# EasyEDA Pro project BlueberryPi.eprj, board PCB1 (continued)
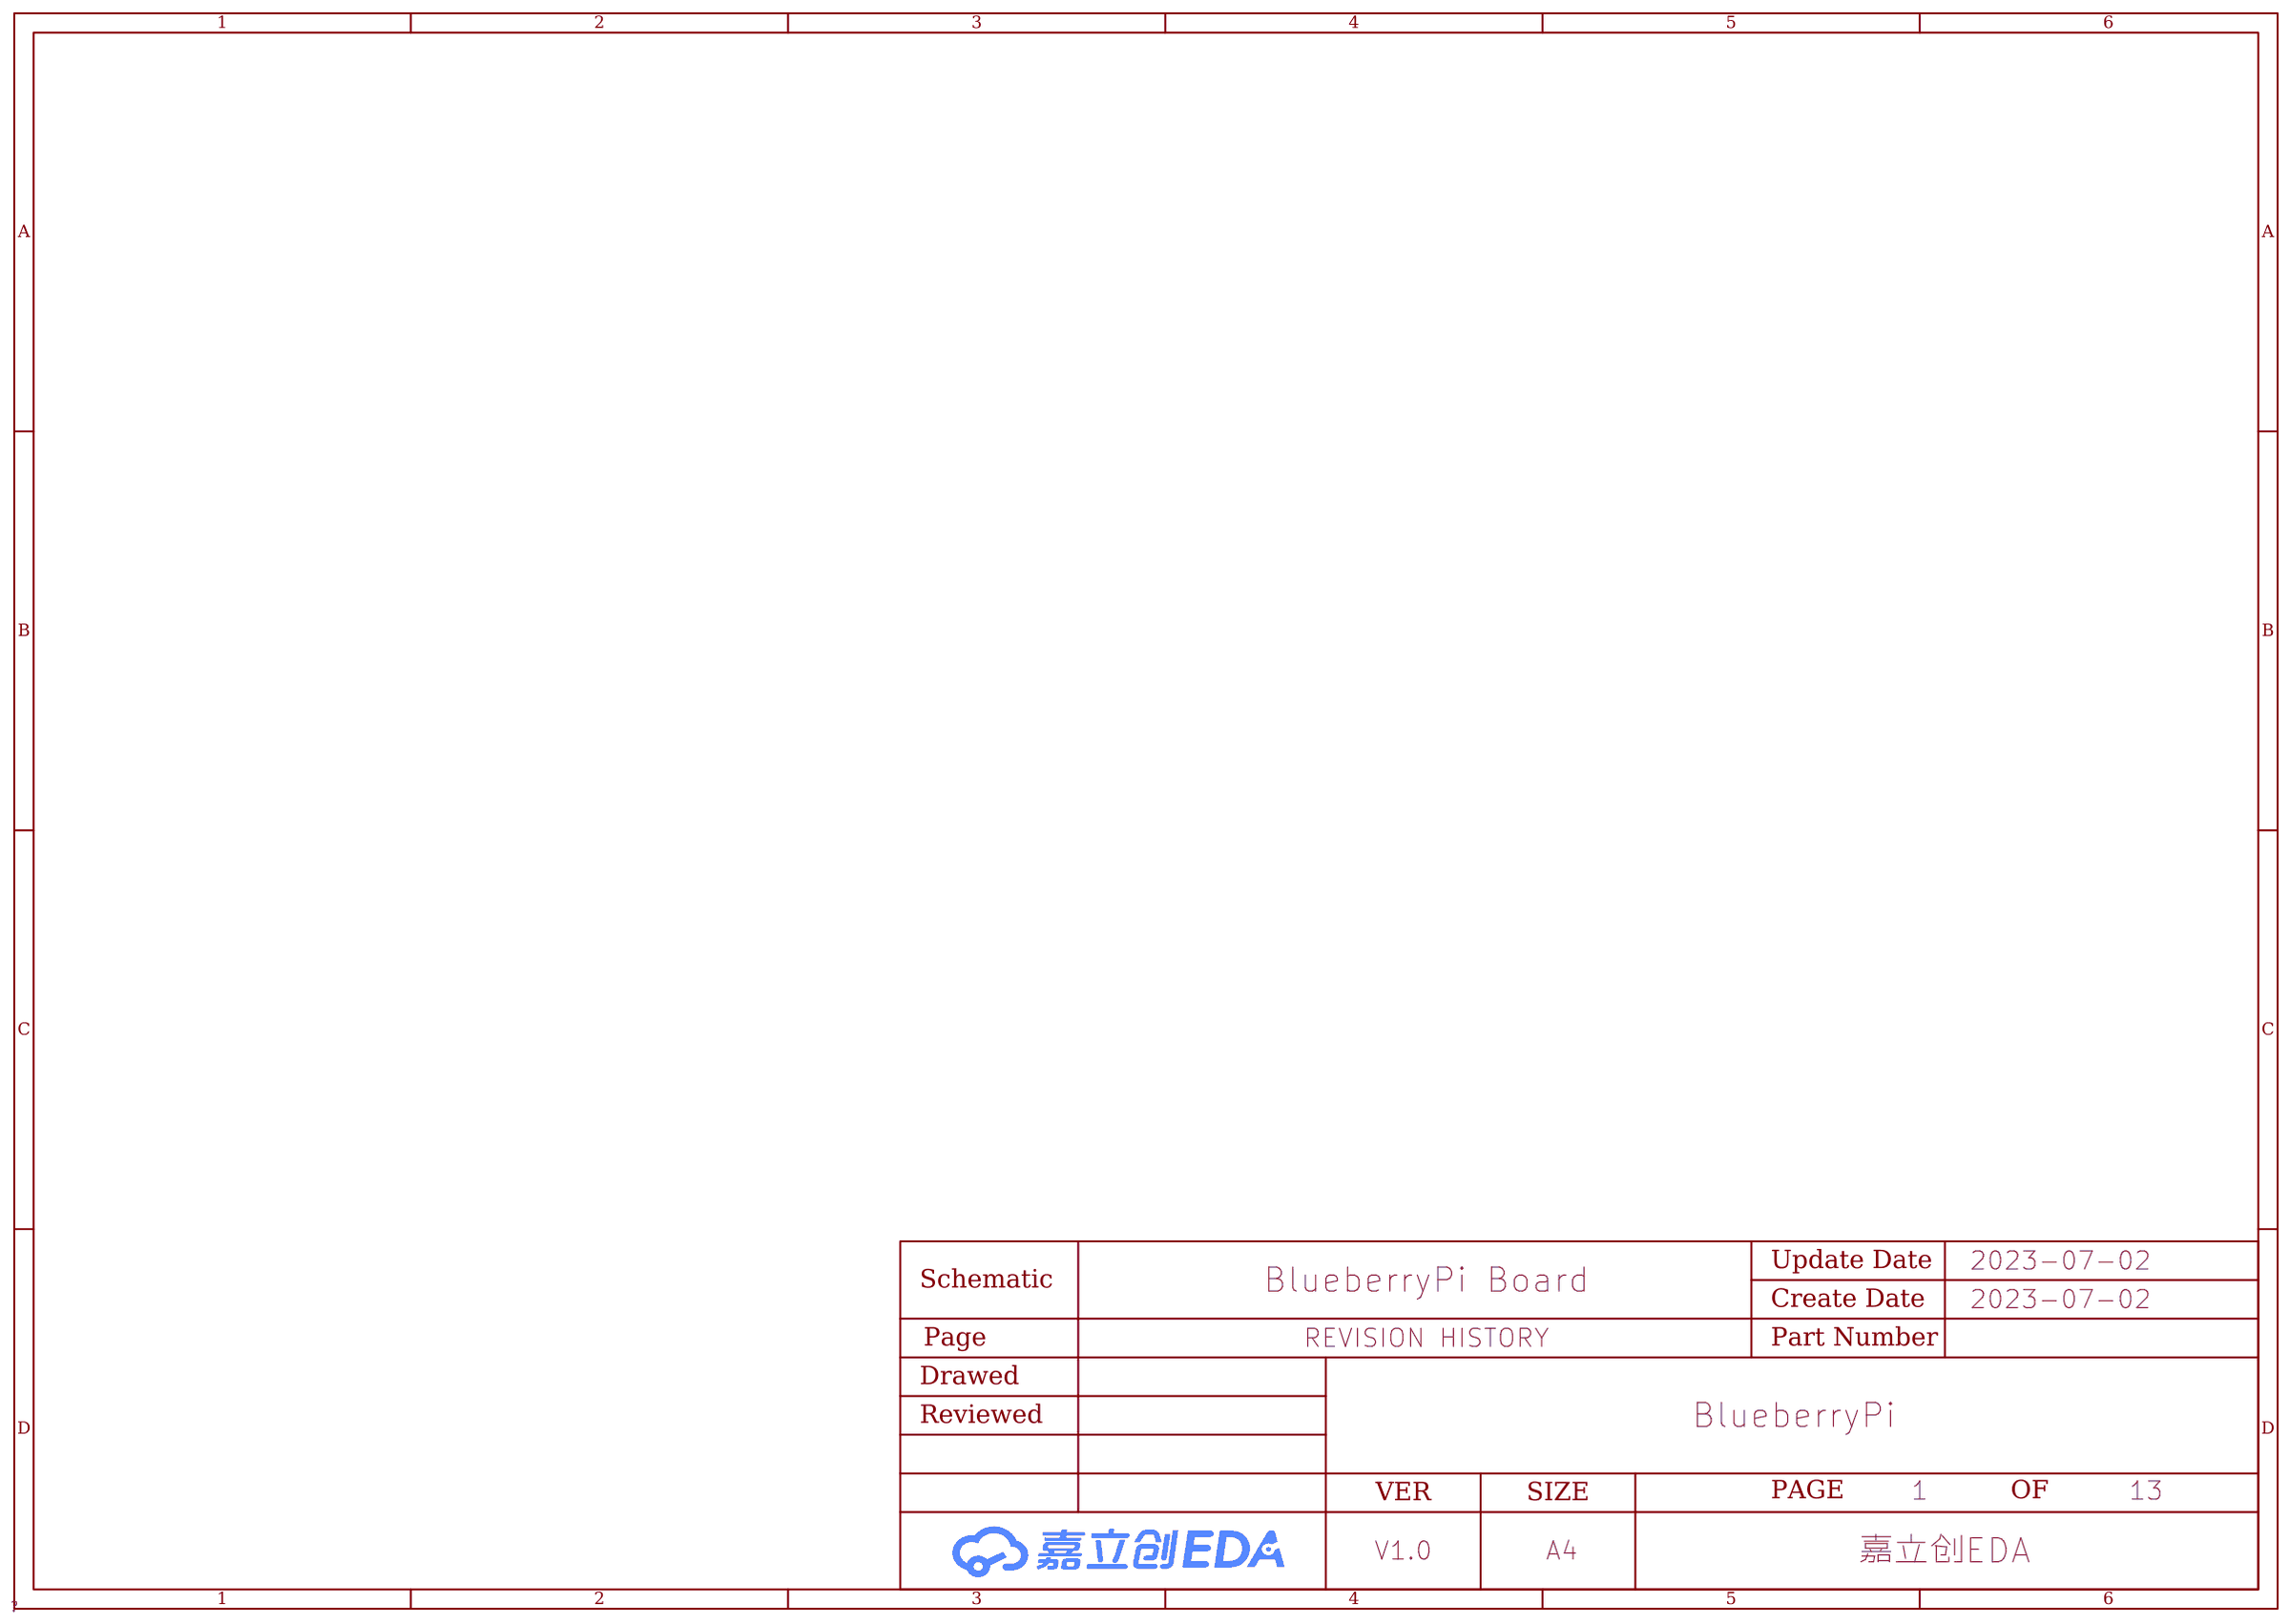
[diagram p0: REVISION HISTORY]
## Routing (per net, layer and track width the routed paths; a pad name or vN(x,y) marks a point on that pad's centre or on a via; arc(x,y) is an arc through that point) (continued)
SODT0: length 36.7
  Top Layer w0.127: U35.J8 48.37,27.58 45.45,27.58 v2(45.29,27.75)
  Bottom Layer w0.127: v2(45.29,27.75) 44.65,28.38 44.65,31.01 44.16,31.51 44.16,33.6 arc(44.2,33.68) 44.28,33.72 arc(44.37,33.75) 44.4,33.84 44.4,33.85 arc(44.37,33.94) 44.28,33.97 arc(44.2,34.01) 44.16,34.09 44.16,34.1 arc(44.2,34.19) 44.28,34.23 arc(44.37,34.26) 44.4,34.35 44.4,34.36 arc(44.37,34.44) 44.28,34.48 arc(44.2,34.52) 44.16,34.6 44.16,34.61 arc(44.2,34.7) 44.28,34.73 arc(44.37,34.77) 44.4,34.86 44.4,34.87 arc(44.37,34.95) 44.28,34.99 arc(44.2,35.02) 44.16,35.11 44.16,35.12 arc(44.2,35.21) 44.28,35.24 arc(44.37,35.28) 44.4,35.36 44.4,35.37 arc(44.37,35.46) 44.28,35.5 arc(44.2,35.53) 44.16,35.62 44.16,35.63 arc(44.2,35.71) 44.28,35.75 arc(44.37,35.79) 44.4,35.87 44.4,35.88 arc(44.37,35.97) 44.28,36 arc(44.2,36.04) 44.16,36.13 44.16,36.14 arc(44.2,36.22) 44.28,36.26 arc(44.37,36.29) 44.4,36.38 44.4,36.39 arc(44.37,36.48) 44.28,36.51 arc(44.2,36.55) 44.16,36.63 44.16,36.64 arc(44.2,36.73) 44.28,36.77 arc(44.37,36.8) 44.4,36.89 44.4,36.9 arc(44.37,36.98) 44.28,37.02 arc(44.2,37.06) 44.16,37.14 44.16,37.15 arc(44.2,37.24) 44.28,37.27 arc(44.37,37.31) 44.4,37.4 44.4,37.41 arc(44.37,37.49) 44.28,37.53 arc(44.2,37.56) 44.16,37.65 44.16,37.66 arc(44.2,37.75) 44.28,37.78 arc(44.37,37.82) 44.4,37.9 44.4,37.91 arc(44.37,38) 44.28,38.04 arc(44.2,38.07) 44.16,38.16 44.16,38.17 arc(44.2,38.25) 44.28,38.29 arc(44.37,38.33) 44.4,38.41 44.4,38.42 arc(44.37,38.51) 44.28,38.54 arc(44.2,38.58) 44.16,38.67 44.16,38.95 47.19,41.98 arc(47.28,42.02) 47.37,41.98 48.1,41.25 arc(48.28,41.25) 48.28,41.43 47.55,42.16 arc(47.55,42.34) 47.73,42.34 48.46,41.61 arc(48.64,41.61) 48.64,41.79 47.91,42.52 arc(47.91,42.7) 48.09,42.7 48.82,41.97 arc(49,41.97) 49,42.15 48.27,42.88 arc(48.27,43.06) 48.45,43.06 49.18,42.33 arc(49.36,42.33) 49.36,42.51 48.63,43.24 arc(48.59,43.33) 48.63,43.42 48.89,43.68 v2(50.18,43.68)
SPI1-CLK: length 153.1
  Top Layer w0.127: U1.E12 49.87,54.42 49.87,54.9 49.73,55.04 49.38,55.04 48.87,55.55 48.87,56.81 48.45,57.23 48.2,57.23 47.35,58.08 46.99,58.08 46.52,58.55 v2(46.52,64.12)
  03SIG w0.127: v2(46.52,64.12) 46.52,65.44 50.99,69.91 84.49,69.91 91.08,63.32 91.08,9.49 87.6,6.01 67.54,6.01 65.53,8.01 62.05,8.01 60.96,6.92 60.96,4.76 61.91,3.81 U7.23
SPI1-CS: length 150.2
  Top Layer w0.127: v2(45.72,63.16) 45.72,58.6 46.75,57.57 47.1,57.57 47.9,56.77 47.9,55.85 48.88,54.88 U1.D11
  03SIG w0.127: v2(45.72,63.16) 45.72,65.79 50.43,70.5 84.85,70.5 92.48,62.87 92.48,9.87 87.74,5.13 63.45,5.13 U7.24
SPI1-MISO: length 156.5
  Top Layer w0.127: v2(45.33,63.7) 45.33,58.52 46.57,57.28 46.75,57.28 47.26,56.77 47.26,55.85 47.41,55.7 47.7,55.7 47.88,55.52 47.88,55.03 U1.D9
  03SIG w0.127: v2(45.33,63.7) 45.33,65.98 50.13,70.78 85,70.78 93.34,62.44 93.34,9.71 85.64,2.01 61.49,2.01 U7.21
SPI1-MOSI: length 168.7
  Bottom Layer w0.127: v2(47.58,53.47) 47.89,53.78 47.89,54.66 47.54,55.01 47.54,66.8 58.57,77.83 70.7,77.83 72.15,76.38 72.15,75.63 73.86,73.91 80.3,73.91 81.09,74.7 81.09,75.6 81.48,76 89.26,76 92.32,72.93 92.32,11.14 83.72,2.54 58.42,2.54 U7.19
STATUS-LED: length 24.8
  Top Layer w0.127: U1.J21 55.7,51.16 56.27,51.16 56.59,51.47 57.85,51.47 58.9,50.42 63.76,50.42 68.06,54.71 68.06,58.41 70.61,60.96 v2(72.91,60.96)
SVREF: length 46.3
  Top Layer w0.127: R20.1 47.16,20.03 47.16,19.66 R21.2 ; U35.H4 49.26,25.92 50.33,25.92 50.5,25.76 50.5,25.43 50.75,25.18 51.04,25.18 51.18,25.03 51.18,24.42 51.31,24.3 51.56,24.3 51.79,24.07 v2(51.79,21.69)
  Top Layer w0.254: R20.1 45.53,20.47 v2(45.47,20.41)
  Bottom Layer w0.127: v2(51.79,21.69) 50.51,20.41 v2(45.47,20.41) 45.47,20.98 41.26,25.18 41.26,42.98 43.29,45.01 45.01,45.01 v2(45.63,45.63)
SVREF_DQ: length 6.4
  Top Layer w0.127: 49.86,32.61 49.86,31.47 U35.J11
  Top Layer w0.254: 49.06,35.5 R23.2 ; 49.06,35.5 C72.2 49.06,33.41 49.86,32.61 ; 49.06,35.5 49.15,35.41 R22.1
TWI0-SCK: length 60.5
  Top Layer w0.127: U7.5 40.65,5.09 40.65,8.12 v2(39.37,9.41) ; v2(42.75,9.41) 42.75,10.87 40.11,13.51 36.31,13.51 34.98,14.84 34.98,44.91 36.66,46.6 43.36,46.6 U1.U3
  Bottom Layer w0.127: v2(39.37,9.41) 42.74,9.41 v2(42.75,9.41)
TWI0-SDA: length 64.8
  Top Layer w0.127: U1.R5 44.01,46.61 44.01,46.19 43.78,45.96 36.88,45.96 35.45,44.53 35.45,15.2 36.66,13.98 40.35,13.98 43.6,10.73 v2(43.6,10) ; U7.3 38.11,5.09 38.11,8.12 v2(36.83,9.41)
  Bottom Layer w0.127: v2(43.6,10) 37.42,10 v2(36.83,9.41)
UART3-RX: length 58.9
  Top Layer w0.127: U1.V1 41.73,45.63 41.66,45.55 41.42,45.55 41.24,45.73 40.96,45.73 40.79,45.55 40.51,45.55 40.33,45.73 40.05,45.73 39.87,45.55 39.59,45.55 39.41,45.73 39.14,45.73 38.96,45.55 38.68,45.55 38.5,45.73 38.22,45.73 38.04,45.55 37.76,45.55 37.59,45.73 37.31,45.73 37.13,45.55 36.94,45.55 35.78,44.39 35.78,15.27 36.82,14.23 40.68,14.23 45.68,9.22 v2(45.68,9.05)
  Bottom Layer w0.127: v2(45.68,9.05) 45.86,9.05 45.95,8.95 45.95,8.77 45.7,8.52 45.7,8.34 45.85,8.2 46.03,8.2 46.27,8.45 46.45,8.45 46.6,8.3 46.6,8.12 46.35,7.88 46.35,7.7 46.49,7.55 46.67,7.55 46.92,7.8 47.1,7.8 48.13,6.77 48.13,3.85 48.09,3.81 U7.11
UART3-TX: length 58.9
  Top Layer w0.127: v2(46.04,9.4) 45.86,9.4 40.78,14.48 36.93,14.48 36.03,15.38 36.03,44.28 37.05,45.3 41.66,45.3 41.73,45.22 v2(41.86,45.22)
  Bottom Layer w0.127: v2(46.04,9.4) 46.04,9.23 48.39,6.87 48.39,3.85 48.43,3.81 U7.13 ; v2(41.86,45.22) 42.6,45.22 43.65,46.28 v2(44.98,46.28)
UBOOT: length 69.7
  Top Layer w0.305: v2(82.65,20.09) C133.2
  03SIG w0.127: v2(52.78,52.78) 52.78,51.93 51.64,50.79 51.64,48.07 52.41,47.3 55.75,47.3 56.53,48.07 56.53,49.21 57.12,49.81 65.67,49.81 67.2,51.33 67.41,51.33 67.78,51.7 77.43,51.7 80.89,48.25 80.89,21.86 v2(82.65,20.09)
USB0-DM: length 46.7
  Top Layer w0.127: v2(48.48,57.62) 48.35,57.75 48.03,57.75 46.88,58.89 46.88,72.61 45.11,74.38 39.35,74.38 33.12,80.62 33.12,86.73 U51.2 33.12,87.87 33.12,89.3 33.08,89.34 USB2.2
  Bottom Layer w0.127: v2(48.48,57.62) 48.74,57.62 48.87,57.75 49.97,57.75 50.1,57.62 50.1,57.44 50.05,57.4 50.05,57.22 50.2,57.08 50.38,57.08 50.42,57.12 50.6,57.12 50.75,56.97 50.75,56.55 50.69,56.49 50.55,56.49 50.37,56.68 v2(50.18,56.68)
USB0-DP: length 46.8
  Top Layer w0.127: v2(48.48,58.13) 48.35,58 48.13,58 47.14,59 47.14,72.72 45.22,74.64 39.46,74.64 33.38,80.72 33.38,86.73 U52.2 33.38,87.87 33.38,89.3 33.42,89.34 USB2.3
  Bottom Layer w0.127: v2(50.18,56.03) 50.37,56.03 50.58,56.24 50.8,56.24 51,56.45 51,57.08 50.08,58 48.87,58 48.74,58.13 v2(48.48,58.13)
USB1-DM: length 36.1
  Top Layer w0.102: v2(51.79,60.5) 51.79,60.7 52.07,60.98 52.07,80.93 53.09,81.95 53.09,82.56 53.12,82.6 v3(53.45,82.6)
  Bottom Layer w0.102: v2(52.17,56.03) 52.17,55.86 52.14,55.82 51.72,55.82 51.59,55.96 51.59,56.04 arc(51.63,56.15) 51.74,56.2 51.75,56.2 arc(51.91,56.35) 51.75,56.5 51.74,56.5 arc(51.63,56.54) 51.59,56.65 51.59,59.62 51.38,59.82 51.38,60.29 51.48,60.39 51.67,60.39 v2(51.79,60.5) ; v3(53.45,82.6) 53.12,82.6 53.09,82.64 53.09,82.86 50.95,84.99 50.95,85.93 49.95,86.93 49.95,87.06 49.99,87.1 50.84,87.1
USB1-DP: length 36.1
  Top Layer w0.102: v2(51.43,60.86) 51.63,60.86 51.84,61.07 51.84,81.02 52.86,82.04 52.86,82.56 52.82,82.6 v3(52.5,82.6)
  Bottom Layer w0.102: v2(52.17,55.38) 52.17,55.56 52.14,55.59 51.63,55.59 51.36,55.86 51.36,59.52 51.15,59.73 51.15,60.39 51.32,60.55 51.32,60.75 v2(51.43,60.86) ; v3(52.5,82.6) 52.82,82.6 52.86,82.64 52.86,82.76 50.72,84.89 50.72,85.83 49.72,86.84 49.72,87.06 49.68,87.1 48.84,87.1
USB1-SSRXN: length 33.1
  Top Layer w0.127: 45.84,85.6 46.66,85.6 46.71,85.56 46.71,85.21 48.21,83.71 48.91,83.71 48.96,83.67 48.96,83.6 48.84,83.48 D2.10 D2.1 48.84,81.72 48.96,81.6 48.96,61.44 48.83,61.31 48.83,61.13 48.96,61 48.96,60.83 48.83,60.7 48.83,60.52 48.96,60.4 48.96,60.22 48.83,60.09 48.83,59.91 48.96,59.79 48.96,59.61 48.83,59.48 48.83,59.3 48.96,59.18 48.96,59.09 49.34,58.71 49.34,58.53 49.46,58.41 49.64,58.41 49.82,58.23 50.37,58.23 50.53,58.07 50.53,57.89 50.66,57.76 50.84,57.76 50.93,57.67 50.93,57.41 50.8,57.28 50.8,57.1 50.93,56.98 50.93,56.78 U1.A14
USB1-SSRXP: length 33.1
  Top Layer w0.127: U1.B14 51.18,56.38 51.18,57.78 50.47,58.48 49.92,58.48 49.21,59.19 49.21,81.6 49.34,81.72 D2.2 D2.9 49.34,83.48 49.21,83.6 49.21,83.77 49.02,83.97 48.31,83.97 46.96,85.32 46.96,85.56 47.01,85.6 47.84,85.6
USB1-SSTXN: length 25.6
  Top Layer w0.127: C5.1 50.41,62.78 50.46,62.82 50.46,81.6 50.34,81.72 D2.4 D2.7 50.34,83.48 50.46,83.6 50.46,83.77 50.65,83.97 51.3,83.97 52.71,85.37 52.71,85.56 52.66,85.6 51.84,85.6
USB1-SSTXP: length 25.6
  Top Layer w0.127: 53.84,85.6 53.01,85.6 52.96,85.56 52.96,85.26 51.41,83.71 50.76,83.71 50.71,83.67 50.71,83.6 50.84,83.48 D2.6 D2.5 50.84,81.72 50.71,81.6 50.71,62.82 50.76,62.78 C6.1
USB-VBUS0: length 5.9
  Top Layer w0.508: 30.37,87.27 C126.2 30.37,83.81 ; USB2.1 30.36,88.56 C127.2
USB-VBUS1: length 14.5
  Top Layer w0.508: 53.33,87.1 53.67,87.1 55.32,88.75 57.4,88.75 58.61,87.54 C130.2 C131.2 58.61,79.49
USB-VBUS3: length 23.7
  Top Layer w0.508: 53.33,90.3 51.97,91.67 45.97,91.67 43.84,89.53 42.7,89.53 40.87,87.71 40.87,85.55 42.71,83.71 C129.2 42.71,79.49
VRA1: length 2.9
  Top Layer w0.127: 43.68,57.99 43.68,57.28 44.02,56.93 44.02,55.69 U1.C4
VRA2: length 1.6
  Bottom Layer w0.127: v2(44.33,54.69) 44.74,55.1 C31.2
VREF: length 4.2
  Top Layer w0.203: C96.2 19.71,62.29 19.05,61.63 17.97,61.63 17.08,60.74 U37.29
WIFI-CLK-IN: length 6.6
  Top Layer w0.203: U64.10 17.37,20.33 C143.1 18.5,19.2 18.5,16.95 17.77,16.22 X3.1
WIFI-CLK-OUT: length 4.4
  Top Layer w0.203: U64.11 18.26,20.94 19.7,19.51 19.7,17.98 19.64,17.92
WIFI-PWR-EN: length 66
  03SIG w0.127: v2(46.93,53.47) 46.44,52.97 45.86,52.97 45.25,52.36 45.25,51.73 46,50.99 46,50.25 45.35,49.61 38.84,49.61 31.04,41.81 31.04,9.75 27.91,6.63 v2(21.39,6.63)
WL-REG-ON: length 148.6
  Top Layer w0.127: v2(58.06,49.38) 57.58,49.86 56.54,49.86 56.21,49.53 U1.M22 ; U64.12 v2(21.72,23.09)
  03SIG w0.127: v2(21.72,23.09) 20.71,24.09 14.48,24.09 12.67,22.29 12.67,9.58 16.33,5.92 28.45,5.92 30.91,8.38 59.55,8.38 79.38,28.21 79.38,49.19 77.42,51.14 70.72,51.14 70.31,50.74 67.07,50.74 65.71,49.38 v2(58.06,49.38)
WL-SDIO-CLK: length 2.1
  Top Layer w0.127: R7.2 20.92,27.76 20.74,27.58 U64.17
WL-SDIO-CMD: length 42.3
  Top Layer w0.127: U64.16 20.84,26.7 20.94,26.59 R83.1 21.72,26.91 21.98,27.18 27.61,27.18 33.4,32.97 33.4,45.63 38.26,50.5 43.18,50.5 43.36,50.67 43.36,51.16 U1.J3
WL-SDIO-D0: length 42.7
  Top Layer w0.127: U64.18 20.54,28.47 20.99,28.93 R84.1 22.25,28.4 28,28.4 33.17,33.57 33.17,45.82 38.14,50.79 40.31,50.79 41.13,51.61 42.74,51.61 42.93,51.79 43.89,51.79 44.2,51.48 U1.J5
WL-SDIO-D1: length 40.2
  Top Layer w0.127: U1.H2 42.79,52.13 42.5,51.84 41,51.84 40.17,51.02 37.99,51.02 32.93,45.96 32.93,34.12 28.33,29.53 22.29,29.53 R85.1 21.27,30.1 20.56,29.39 U64.19
WL-SDIO-D2: length 44
  Top Layer w0.127: U64.14 20.36,24.89 20.99,24.26 R81.1 21.72,24.32 22.24,24.84 26.09,24.84 33.63,32.39 33.63,45.47 38.04,49.87 44.67,49.87 U1.L5
WL-SDIO-D3: length 44.2
  Top Layer w0.127: U1.H5 45.29,51.82 45.29,51.27 v2(45,50.98) ; U64.15 20.56,25.78 20.92,25.43 v2(21.72,25.43)
  03SIG w0.127: v2(21.72,25.43) 22.33,26.03 25.23,26.03 30.53,31.33 30.53,42.01 38.44,49.92 40.68,49.92 42.25,51.5 44.49,51.5 45,50.99 v2(45,50.98)
WL-WAKE-AP: length 130.6
  Top Layer w0.127: U64.13 20.52,23.98 20.82,23.69 v2(23.1,23.69)
  03SIG w0.127: v2(29.21,15.74) 29.21,17.58 v2(23.1,23.69)
  Bottom Layer w0.127: v2(29.21,15.74) 31.81,13.13 74.52,13.13 78.61,17.22 78.61,54.47 77.18,55.91 69.7,55.91 63.76,49.97 55.67,49.97 55.55,49.84 55.07,49.84 v2(54.73,50.18)
X32KI: length 8.3
  Top Layer w0.127: X2.4 62.81,57.04 62.81,55.88 61.86,54.93 C41.1 58.18,54.93 U1.F23
X32KO: length 10.9
  Top Layer w0.127: X2.1 63.68,57.04 R17.1 63.68,54.47 C42.1 57.96,54.29 56.8,53.14 56.32,53.14 U1.F22

## Copper pours and planes (outline as drawn; the poured copper is in the pictures)
GND on Top Layer: 0,99.06 99.06,99.06 99.06,0 0,0
GND on Bottom Layer: 0,99.06 99.06,99.06 99.06,0 0,0
GND on 02GND: 0,99.06 99.06,99.06 99.06,0 0,0
GND on 03SIG: 0,99.06 99.06,99.06 99.06,0 0,0
GND on 04PWR: 0,99.06 99.06,99.06 99.06,0 0,0
GND on 05GND: 0,99.06 99.06,99.06 99.06,0 0,0
VCC-DRAM on Top Layer: 16.73,51.76 16.91,51.58 16.91,42.06 17.22,41.76 19.1,41.76 19.44,42.1 19.44,51 18.68,51.76
VCC-DRAM on 04PWR: 53.72,19.77 56.73,22.78 56.73,44.08 54.17,46.63 46.76,46.63 45.12,48.27 24.26,48.27 20.24,44.26 17.32,44.26 16.85,43.78 16.85,39.21 18.12,37.94 32.36,37.94 36.8,33.49 36.8,22.99 40.02,19.77
VDD-CPU on Top Layer: 2.35,61.47 9.68,61.47 10.85,62.64 10.85,67.46 10.06,68.25 4.13,68.25 2.01,66.13 1.99,66.13 1.99,61.83
VDD-CPU on 04PWR: 5.23,63.87 22.61,63.87 29.67,56.81 47.97,56.81 51.22,53.55 51.22,48.54 51.73,48.03 53.01,48.03 53.92,48.94 53.92,57.41 50.24,61.1 33.75,61.1 26.88,67.97 6.09,67.97 4.6,66.48 4.6,64.5
VDD-GPU on Top Layer: 2.15,54 3.56,54 4.17,54.61 9.02,54.61 9.56,54.06 9.56,52.4 8.45,51.28 2.64,51.28 1.63,52.3 1.63,53.48
VDD-GPU on 04PWR: 4.3,53.2 5.17,54.07 9.22,54.07 15.61,47.67 17.75,47.67 22.66,52.58 45.19,52.58 47.86,49.92 47.86,48.08 47.7,47.93 45.97,47.93 45.34,48.55 24.21,48.55 20.06,44.38 9.75,44.38 4.3,49.83
VDD-SYS on Top Layer: 15.18,52.9 16.85,51.23 16.85,45.08 16.46,44.7 14.68,44.7 14.24,45.14 14.24,47.57 14.54,47.88 14.54,52.45 14.99,52.9
VDD-SYS on 04PWR: 15.67,47.74 17.59,47.74 22.62,52.76 47.72,52.76 49.42,51.06 50.75,51.06 51.04,51.34 51.04,53.56 47.95,56.65 21.96,56.65 15.07,49.76 15.07,48.34
$L1_1 on Top Layer: 8.94,58.17 9.96,59.14 9.96,60.85 9.5,61.3 4.07,61.3 3.66,60.89 3.66,58.76 4.25,58.17
$L3_1 on Top Layer: 4.25,57.89 3.71,57.34 3.71,55.28 4.11,54.88 9.53,54.88 10.22,55.58 10.22,56.71 9.04,57.89
$L4_1 on Top Layer: 14.33,53.12 14.33,47.97 13.74,47.38 12.12,47.38 12.11,47.37 11.74,47.74 11.74,50.53
$L5_1 on Top Layer: 17.16,52.33 17.29,52.46 19.17,52.46 20.22,51.41 22.17,51.41 22.69,50.89 22.69,47.45 22.09,46.86 20,46.86 19.5,47.36 19.5,51.21 18.74,51.97 17.45,51.97 17.16,52.26
PS on Top Layer: 6.45,82.99 7.62,82.99 8.21,82.41 8.21,75.59 7.94,75.32 5.28,75.32 5.02,75.59 5.02,79.5 4.11,80.41 4.11,80.66
PS on 04PWR: 17.06,52.08 20.35,55.37 20.35,62.6 19.36,63.6 5.13,63.6 4.38,64.35 4.38,66.76 8.13,70.51 8.13,82.79 7.53,83.39 3.5,83.39 2.5,82.4 2.5,74.83 0.56,72.89 0.56,55.02 1.26,54.32 9.27,54.32 11.51,52.08

Small or netless copper shapes (teardrops, artwork), in the pictures only: 776 on Top Layer, 273 on Bottom Layer, 69 on 03SIG, 28 on 04PWR

## Text on the board
Top Silkscreen Layer: 5V | GND | IO1 | IO4 | IO5 | IO6 | CE0 | PWM0 | 3V3 | SDA | SCK | PWM | IO0 | IO2 | IO3 | MISO | MOSI | CLK | TXD0 | RXD0 | Blueberry Pi 1 | by 指挥官宝哥
